# EasyEDA Pro project DualModeKeyboard.eprj

# Schematic Schematic1
Create Date: 2023-08-28; Page Name: P1; Project Name: DualModeKeyboard; Schematic Name: Schematic1; Update Date: 2023-10-23; Company: xChenNing; Drawed: xChenNing; Page Size: A4; Reviewed: xChenNing; Version: V1.0
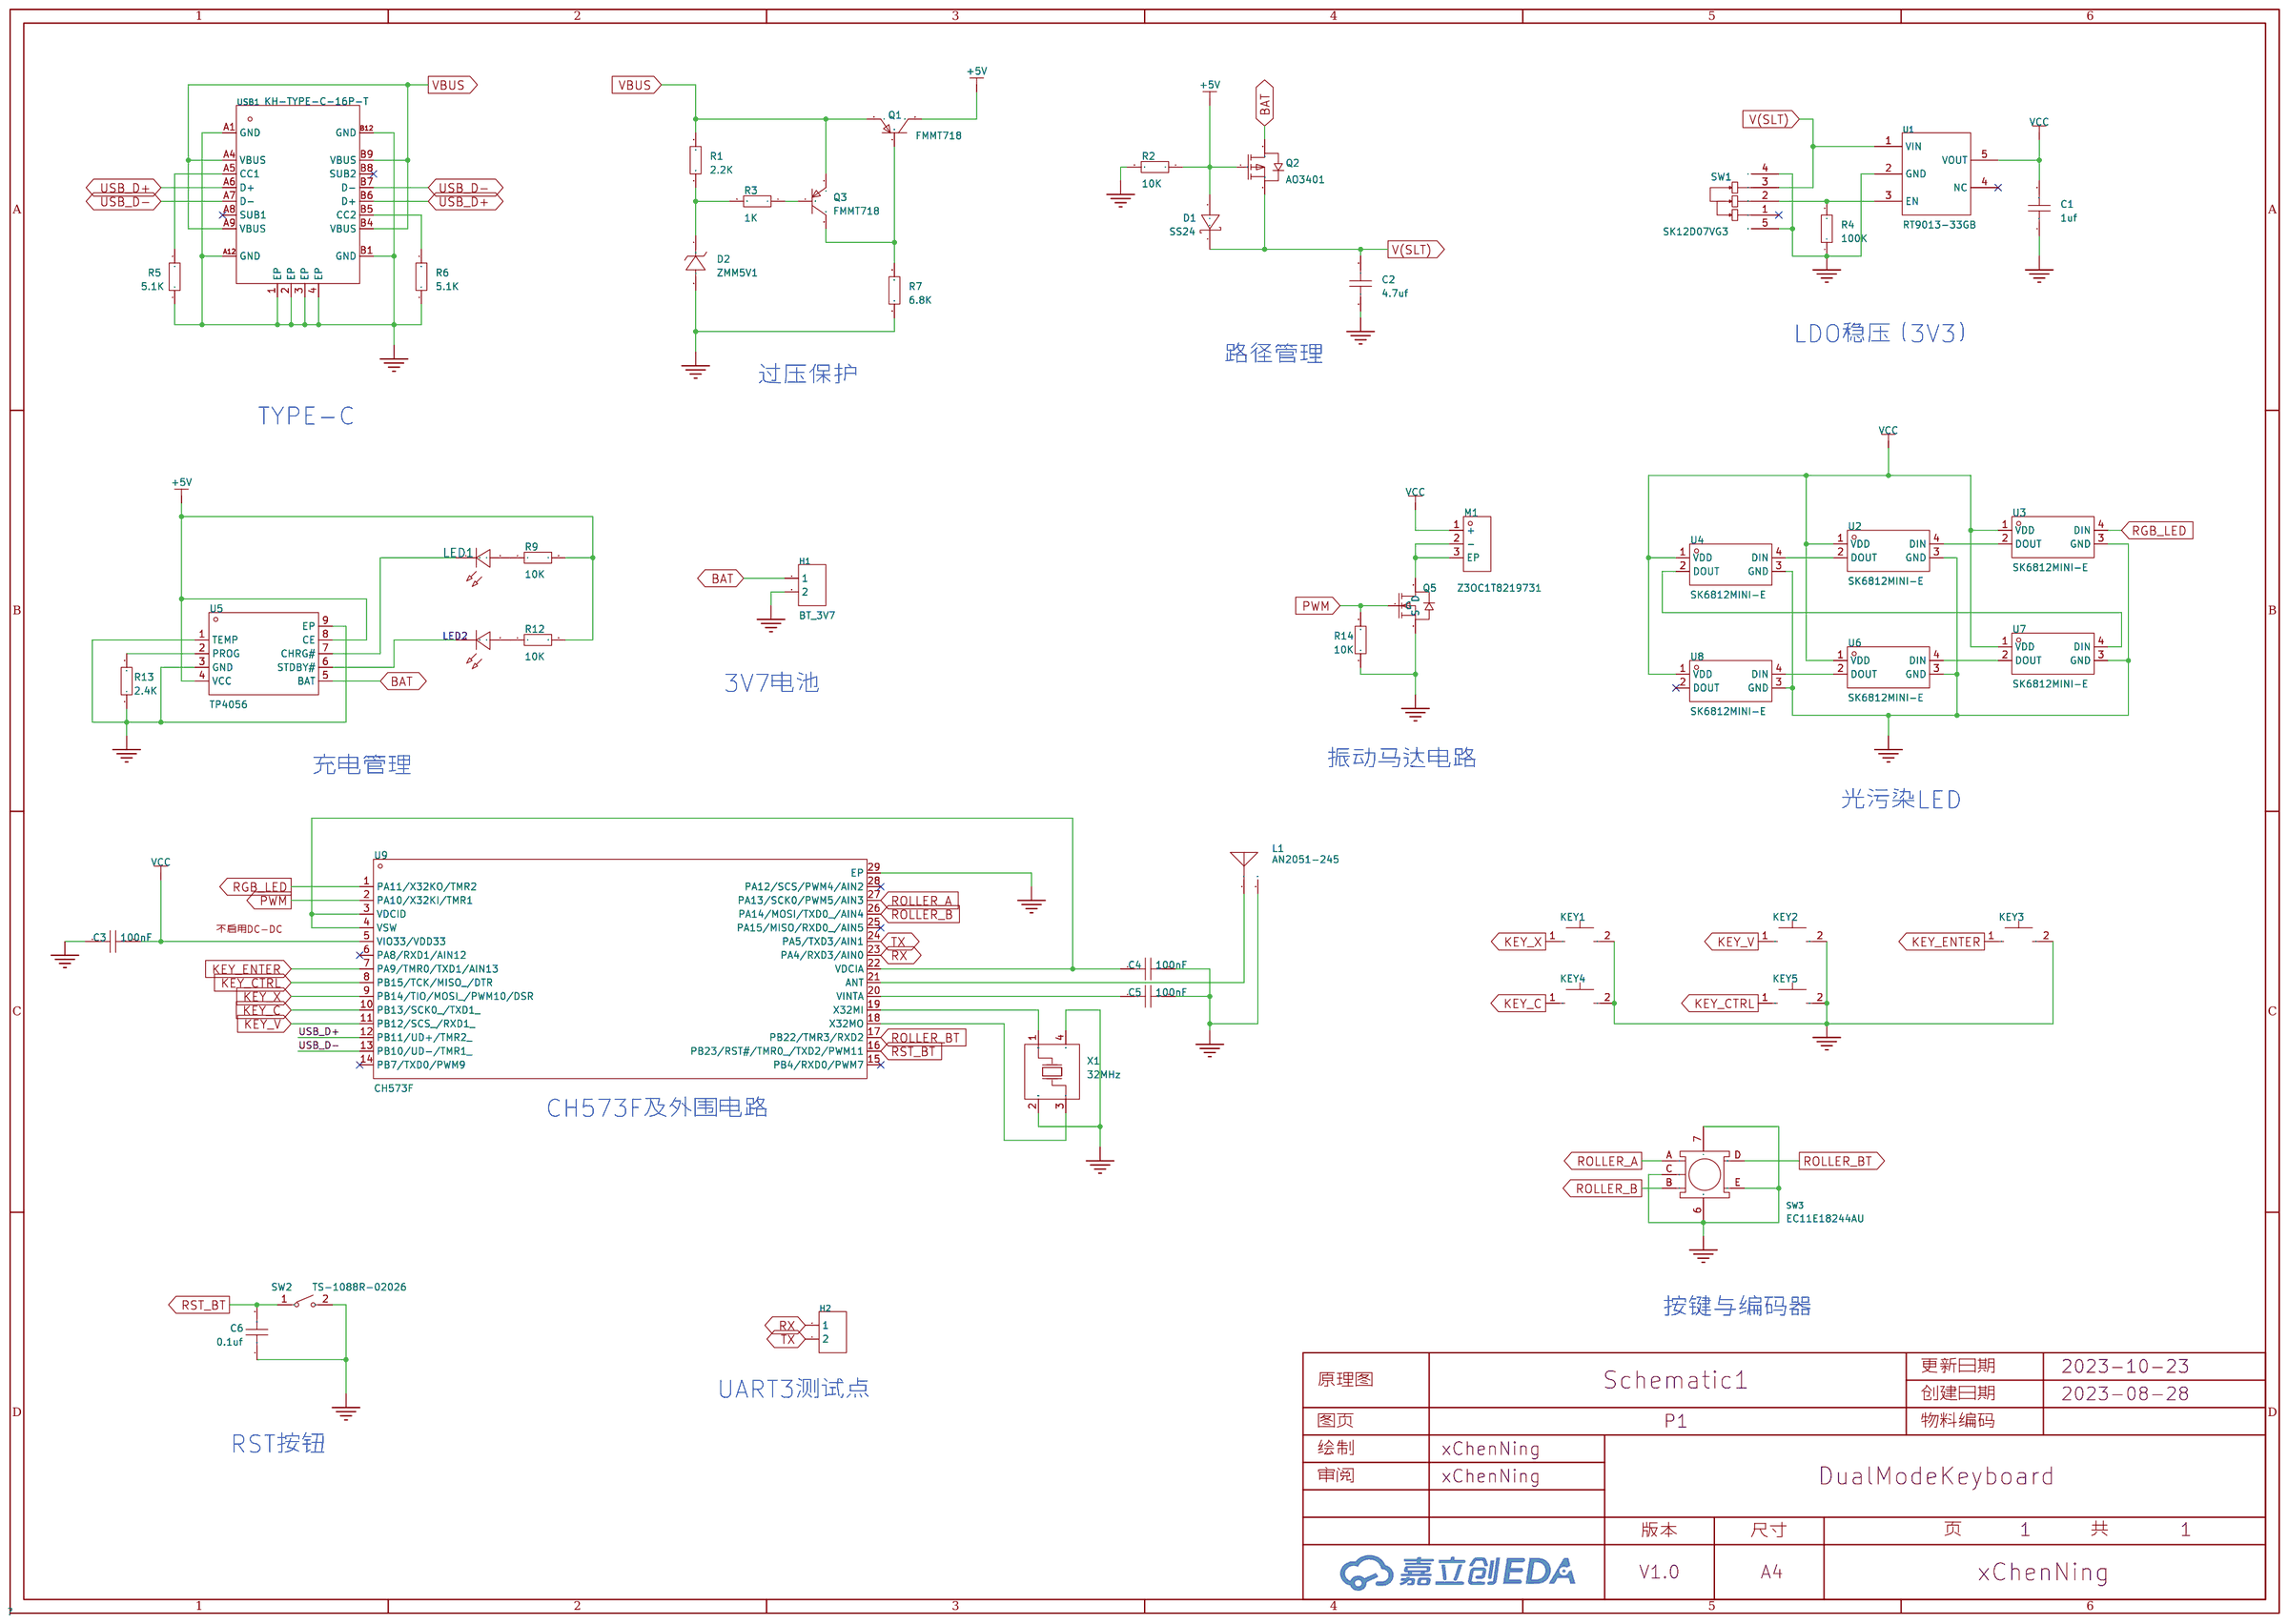
[diagram p0: schematic sheet]

## Parts
C1  1uf  [C0805]
C2  4.7uf  [C0805]
C3  100nF  [C0603]
C4  100nF  [C0603]
C5  100nF  [C0603]
C6  0.1uf  [C0805]
D1  SS24  [SMA_L4.3-W2.6-LS5.2-RD]
D2  ZMM5V1  [LL-34_L3.5-W1.5-RD]
H1  BT_3V7  [HDR-TH_2P-P2.54-V-F]
H2  -  [HDR-TH_2P-P2.54-V-F]
KEY1  CPG151101S11  [AxisSeat_14_18_XCN1]
KEY2  CPG151101S11  [AxisSeat_14_18_XCN1]
KEY3  CPG151101S11  [AxisSeat_14_18_XCN1]
KEY4  CPG151101S11  [AxisSeat_14_18_XCN1]
KEY5  CPG151101S11  [AxisSeat_14_18_XCN1]
L1  AN2051-245  [ANT2051]
LED1  -  [LED_0805]
LED2  -  [LED_0805]
M1  Z3OC1T8219731  [VIBRATING-MOTOR-SMD_3P-C9900001680]
Q1  FMMT718  [SOT-23-3_L2.9-W1.3-P1.90-LS2.4-BR]
Q2  AO3401  [SOT-23-3_L2.9-W1.4-P1.90-LS2.6-BR]
Q3  FMMT718  [SOT-23-3_L2.9-W1.3-P1.90-LS2.4-BR]
Q5  -  [SOT-23-3_L2.9-W1.3-P1.90-LS2.4-BR]
R1  2.2K  [R0805]
R2  10K  [R0805]
R3  1K  [R0805]
R4  100K  [R0805]
R5  5.1K  [R0805]
R6  5.1K  [R0805]
R7  6.8K  [R0805]
R9  10K  [R0805]
R12  10K  [R0805]
R13  2.4K  [R0805]
R14  10K  [R0805]
SW1  SK12D07VG3  [SW-TH_SK12D07VG3]
SW2  TS-1088R-02026  [SW-SMD_L3.9-W3.0-P4.45]
SW3  EC11E18244AU  [SW-TH_EC11XXXXXXXX]
U1  RT9013-33GB  [SOT-23-5_L3.0-W1.7-P0.95-LS2.8-BL]
U2  SK6812MINI-E  [LED-SMD_L3.2-W2.8-TR]
U3  SK6812MINI-E  [LED-SMD_L3.2-W2.8-TR]
U4  SK6812MINI-E  [LED-SMD_L3.2-W2.8-TR]
U5  TP4056  [ESOP-8_L4.9-W3.9-P1.27-LS6.0-BL-EP]
U6  SK6812MINI-E  [LED-SMD_L3.2-W2.8-TR]
U7  SK6812MINI-E  [LED-SMD_L3.2-W2.8-TR]
U8  SK6812MINI-E  [LED-SMD_L3.2-W2.8-TR]
U9  CH573F  [QFN-28_L4.0-W4.0-P0.40-BL-EP]
USB1  KH-TYPE-C-16P-T  [USB-C-SMD_KH-TYPE-C-16P]
X1  32MHz  [OSC-SMD_4P-L2.0-W1.6-BL]

## Library data of the parts
C1 C2 C6 = CAP_0805: Supplier Footprint: 0805
C3-C5 = CAP_0603: Supplier Footprint: 0603
D1 = SS24_C50645: 直流反向耐压(Vr):40V;平均整流电流(Io):2A;正向压降(Vf):550mV@2A;; LCSC Part Name: 40V 2A 550mV@2A SMA （相似料：C364270）; Supplier Part: C50645; Manufacturer: MDD; Supplier Footprint: SMA(DO-214AC); JLCPCB Part Class: 扩展库; Datasheet: https://atta.szlcsc.com/upload/public/pdf/source/20190304/C50645_5B6F2047F1B1EB9F2588B24BC6E81306.pdf; Supplier: LCSC; Reverse Voltage (Vr): 40V; Average Rectified Current (Io): 2A; Forward Voltage (Vf@If): 550mV@2A
D2 = ZMM5V1_C707194: 稳压值(标称值):-;精度:-;功率:500mW;反向电流(Ir):100nA@1V;; LCSC Part Name: 500mW; Supplier Part: C707194; Manufacturer: Slkor(萨科微); Supplier Footprint: LL-34; JLCPCB Part Class: 扩展库; Datasheet: https://atta.szlcsc.com/upload/public/pdf/source/20200721/C707184_776B95022AAA01ECB528B9CFDAFDB27C.pdf; Supplier: LCSC; Power Dissipation: 500mW; Reverse Leakage Current (Ir): 100nA@1V
H1 H2 = HDR-F_2.54_1x2P: Supplier Part: C49661; Supplier Footprint: 插件
KEY1-KEY5 = CPG151101S11: LCSC Part Name: 键盘轴连接器; Supplier Part: C2803348; Manufacturer: Kailh(凯华); Supplier Footprint: SMD; JLCPCB Part Class: 扩展库; Datasheet: https://atta.szlcsc.com/upload/public/pdf/source/20220228/B04A6FE76F6176D3365CC186B3035FED.pdf; Supplier: LCSC
L1 = AN2051-245: 小体积，高增益，WIFI，蓝牙，zigBee 2.4G天线; Supplier Part: C99727; Manufacturer: rainsun(霖昱微); Supplier Footprint: 2x5.1mm; JLCPCB Part Class: 扩展库; Datasheet: https://atta.szlcsc.com/upload/public/pdf/source/20170329/1490752053541.pdf; Supplier: LCSC
LED1 = LED_0805-R: Supplier Footprint: 0805
LED2 = LED_0805-G: Supplier Footprint: 0805
M1 = Z3OC1T8219731: 类型:圆柱直流马达;额定电压:2.7V;额定电流:85mA;额定转速:14000±2500rpm;工作温度:-20℃~+70℃;旋转方向:CW;; Supplier Part: C2894731; Manufacturer: KOTL(金龙机电); JLCPCB Part Class: 扩展库; Datasheet: https://atta.szlcsc.com/upload/public/pdf/source/20210908/21604D4C77F5141C93AFC2CF1DCB74B9.pdf; Supplier: LCSC; Type: 圆柱直流马达; Rated Voltage: 2.7V; Rated Current: 85mA; Rated Speed: 14000±2500rpm; Operating Temperature: -20℃~+70℃; Sense Of Rotation: CW
Q1 Q3 = FMMT718_C5277995: 晶体管类型:PNP;集射极击穿电压(Vceo):20V;集电极电流(Ic):1.5A;; LCSC Part Name: PNP 20V 1.5A; Supplier Part: C5277995; Manufacturer: MSKSEMI(美森科); Supplier Footprint: SOT-23; JLCPCB Part Class: Extended Part; Datasheet: https://atta.szlcsc.com/upload/public/pdf/source/20221121/C72142E7E170B7064C711B5C0E67A49A.pdf; Supplier: LCSC; Transistor Type: PNP; Collector-Emitter Breakdown Voltage (Vceo): 20V; Collector Current (Ic): 1.5A
Q2 = AO3401_C727156: 类型:P沟道;漏源电压(Vdss):30V;连续漏极电流(Id):4.2A;功率(Pd):350mW;导通电阻(RDS(on)@Vgs,Id):65mΩ@10V,4.2A;; LCSC Part Name: P沟道 30V 4.2A; Supplier Part: C727156; Manufacturer: TWGMC(台湾迪嘉); Supplier Footprint: SOT-23; JLCPCB Part Class: 扩展库; Datasheet: https://atta.szlcsc.com/upload/public/pdf/source/20200827/C727156_6E081BBEEFBC6B8FEE164CB196B0AF30.pdf; Supplier: LCSC; Type: P沟道; Drain Source Voltage (Vdss): 30V; Continuous Drain Current (Id): 4.2A; Power Dissipation (Pd): 350mW; Drain Source On Resistance (RDS(on)@Vgs,Id): 65mΩ@10V,4.2A; Gate Threshold Voltage (Vgs(th)@Id): 1.3V@250uA
Q5 = AO3400A_N: 类型:N沟道;漏源电压(Vdss):30V;连续漏极电流(Id):5.2A;功率(Pd):1W;导通电阻(RDS(on)@Vgs,Id):35mΩ@10V,5A;阈值电压(Vgs(th)@Id):1.5V@250μA;; Supplier Footprint: SOT-23; Supplier Part: C700953
R1-R7 R9 R12-R14 = Res_0805: Supplier Footprint: 0805
SW1 = SK12D07VG3: LCSC Part Name: 两档位卧式拨动开关,柄长3MM; Supplier Part: C431547; Manufacturer: SHOU HAN(首韩); Supplier Footprint: 插件; JLCPCB Part Class: 扩展库; Supplier: LCSC
SW2 = TS-1088R-02026: 触点电流:50mA;额定电压(DC):12V;电路结构:单刀单掷;安装方式:立贴;带灯:-;机械寿命:-;; LCSC Part Name: 3.9*2.93*2mm 立贴 轻触开关; Supplier Part: C455280; Manufacturer: XUNPU(讯普); Supplier Footprint: SMD,3x4mm; JLCPCB Part Class: 扩展库; Datasheet: https://atta.szlcsc.com/upload/public/pdf/source/20191118/C455280_718CC4284DAF75EEB0AC8229AE7E40C5.pdf; Supplier: LCSC; Contact Current: 50mA; Voltage Rating (DC): 12V; Circuit: 单刀单掷; Mounting Style: 立贴; Actuator Style: 圆形按钮; Switch Length: 3.9mm; Switch Width: 2.93mm; Switch Height: 2mm
SW3 = EC11E18244AU: Supplier Part: C202365; Manufacturer: ALPSALPINE(阿尔卑斯阿尔派); Supplier Footprint: 插件; JLCPCB Part Class: 扩展库; Datasheet: https://atta.szlcsc.com/upload/public/pdf/source/20180403/C202365_70FA927E879F562641EADC151E1E414A.pdf; Supplier: LCSC
U1 = RT9013-33GB: 输出类型:固定;输出极性:正;最大输入电压:5.5V;输出电压:3.3V;输出电流:500mA;电源纹波抑制比(PSRR):50dB@(10kHz);; LCSC Part Name: 输入5.5V 输出3.3V 500mA; Supplier Part: C47773; Manufacturer: RICHTEK(立锜); Supplier Footprint: SOT-23-5; JLCPCB Part Class: 扩展库; Datasheet: https://atta.szlcsc.com/upload/public/pdf/source/20150504/1457707282459.pdf; Supplier: LCSC; Output Type: 固定; Output Polarity: 正; Number of Outputs: 1; Maximum Input Voltage: 5.5V; Output Voltage: 3.3V; Dropout Voltage: 400mV@(500mA); Quiescent Current (Ground Current): 50uA; Output Current: 500mA; Power Supply Rejection Ratio (PSRR): 50dB@(10kHz); Operating Temperature: -40℃~+85℃
U2-U4 U6-U8 = SK6812MINI-E_C5149201: Supplier Part: C5149201; Manufacturer: 欧思科光电; Supplier Footprint: SMD; JLCPCB Part Class: 扩展库; Supplier: LCSC
U5 = TP4056_C725790: Supplier Part: C725790; Manufacturer: UMW(友台半导体); Supplier Footprint: ESOP-8; JLCPCB Part Class: 扩展库; Datasheet: https://atta.szlcsc.com/upload/public/pdf/source/20211011/37515E71BA298E23D23475482C49633D.pdf; Supplier: LCSC
U9 = CH573F: Supplier Part: C2830434; Supplier Footprint: QFN-28; JLCPCB Part Class: 扩展库; Datasheet: https://atta.szlcsc.com/upload/public/pdf/source/20211009/C2830434_9B1CC9FF0455758F5FF7F545AE5FEE38.pdf; Supplier: LCSC
USB1 = KH-TYPE-C-16P-T: 连接器类型:Type-C;标准:-;公母:母座;触点数量:16P;端口数量:1;安装方式:卧贴;额定电流 - 电源:500mA;工作温度范围:-30℃~+80℃;; LCSC Part Name: Type-C 母座 卧贴; Supplier Part: C709358; Manufacturer: kinghelm(金航标); Supplier Footprint: SMD; JLCPCB Part Class: 扩展库; Datasheet: https://atta.szlcsc.com/upload/public/pdf/source/20200722/C709358_5A99A991362FD50EC94EB58A838F95BB.pdf; Supplier: LCSC; Connector Type: Type-C; Gender: 母座; Number of Contacts: 16P; Number of Ports: 1; Mounting Style: 卧贴; Current Rating - Power (Max): 500mA; Operating Temperature Range: -30℃~+80℃
X1 = X201632MMB4SI: 频率:32MHz;频率公差:±10ppm;负载电容:10pF;; LCSC Part Name: 32MHz ±10ppm 10pF YSX211SL; Supplier Part: C383840; Manufacturer: YXC(扬兴晶振); Supplier Footprint: SMD2016-4P; JLCPCB Part Class: 扩展库; Datasheet: https://atta.szlcsc.com/upload/public/pdf/source/20210329/C108154_97241DDF47B5B71D7D93F8906D63DA2F.pdf; Supplier: LCSC; Crystal Type: 贴片无源晶振; Frequency Tolerance: ±10ppm; Frequency Stability: ±20ppm; Load Capacitance: 10pF; Operating Temperature: -40℃~+85℃

## Nets
+5V: D1.2(A) Q1.3(C) Q2.1(G) R2.1 R9.2 R12.2 U5.4(VCC) U5.8(CE)
GND: C1.1 C2.1 C3.1 C4.2 C5.2 C6.1 D2.2(A) H1.2 KEY1.2 KEY2.2 KEY3.2 KEY4.2 KEY5.2 L1.2 Q5.2(S) R2.2 R4.1 R5.1 R6.1 R7.1 R13.1 R14.1 SW1.4 SW1.5 SW2.2 SW3.6 SW3.7 SW3.C SW3.E U1.2(GND) U2.3(GND) U3.3(GND) U4.3(GND) U5.1(TEMP) U5.3(GND) U5.9(EP) U6.3(GND) U7.3(GND) U8.3(GND) U9.29(EP) USB1.1(EP) USB1.2(EP) USB1.3(EP) USB1.4(EP) USB1.A1(GND) USB1.A12(GND) USB1.B1(GND) USB1.B12(GND) X1.2(GND) X1.4(GND)
VBUS: Q1.2(E) Q3.2(E) R1.2 USB1.A4(VBUS) USB1.A9(VBUS) USB1.B4(VBUS) USB1.B9(VBUS)
VCC: C1.2 C3.2 M1.1(+) U1.5(VOUT) U2.1(VDD) U3.1(VDD) U4.1(VDD) U6.1(VDD) U7.1(VDD) U8.1(VDD) U9.5(VIO33/VDD33)
BAT: H1.1 Q2.3(D) U5.5(BAT)
KEY_C: KEY4.1 U9.10(PB13/SCK0_/TXD1_)
KEY_CTRL: KEY5.1 U9.8(PB15/TCK/MISO_/DTR)
KEY_ENTER: KEY3.1 U9.7(PA9/TMR0/TXD1/AIN13)
KEY_V: KEY2.1 U9.11(PB12/SCS_/RXD1_)
KEY_X: KEY1.1 U9.9(PB14/TIO/MOSI_/PWM10/DSR)
PWM: Q5.1(G) R14.2 U9.2(PA10/X32KI/TMR1)
RGB_LED: U3.4(DIN) U9.1(PA11/X32KO/TMR2)
ROLLER_A: SW3.A U9.27(PA13/SCK0/PWM5/AIN3)
ROLLER_B: SW3.B U9.26(PA14/MOSI/TXD0_/AIN4)
ROLLER_BT: SW3.D U9.17(PB22/TMR3/RXD2)
RST_BT: C6.2 SW2.1 U9.16(PB23/RST#/TMR0_/TXD2/PWM11)
RX: H2.1 U9.23(PA4/RXD3/AIN0)
TX: H2.2 U9.24(PA5/TXD3/AIN1)
USB_D+: U9.12(PB11/UD+/TMR2_) USB1.A6(D+) USB1.B6(D+)
USB_D-: U9.13(PB10/UD-/TMR1_) USB1.A7(D-) USB1.B7(D-)
V(SLT): C2.2 D1.1(K) Q2.2(S) SW1.3 U1.1(VIN)
$1N588: C5.1 U9.20(VINTA)
$1N5446: R5.2 USB1.A5(CC1)
$1N5462: R6.2 USB1.B5(CC2)
$1N6903: R4.2 SW1.2 U1.3(EN)
$1N8513: LED1.1(C) U5.7(CHRG#)
$1N8523: LED2.1(C) U5.6(STDBY#)
$1N8602: LED1.2(A) R9.1
$1N8604: LED2.2(A) R12.1
$1N8691: R13.2 U5.2(PROG)
$1N9465: C4.1 U9.3(VDCID) U9.4(VSW) U9.22(VDCIA)
$1N9696: U9.18(X32MO) X1.3(OSC2)
$1N9702: U9.19(X32MI) X1.1(OSC1)
$1N12595: D2.1(C) R1.1 R3.2
$1N12597: Q3.1(B) R3.1
$1N12605: Q1.1(B) Q3.3(C) R7.2
$1N13146: L1.1(ANT) U9.21(ANT)
$1N19892: U2.4(DIN) U3.2(DOUT)
$1N19911: U6.4(DIN) U7.2(DOUT)
$1N19914: U6.2(DOUT) U8.4(DIN)
$1N19980: U2.2(DOUT) U4.4(DIN)
$1N19985: U4.2(DOUT) U7.4(DIN)
$1N28669: M1.2(-) M1.3(EP) Q5.3(D)

Not connected (* = marked no-connect by the designer): SW1 1*; U1 4(NC)*; U8 2(DOUT)*; U9 6(PA8/RXD1/AIN12)* 14(PB7/TXD0/PWM9)* 15(PB4/RXD0/PWM7)* 25(PA15/MISO/RXD0_/AIN5)* 28(PA12/SCS/PWM4/AIN2)*; USB1 A8(SUB1)* B8(SUB2)*

## Notes on the sheet
- LDO稳压（3V3）
- 路径管理
- 过压保护
- TYPE-C
- 3V7电池
- 充电管理
- 振动马达电路
- 光污染LED
- 不启用DC-DC
- CH573F及外围电路
- 按键与编码器
- UART3测试点
- RST按钮

# Board PCB1
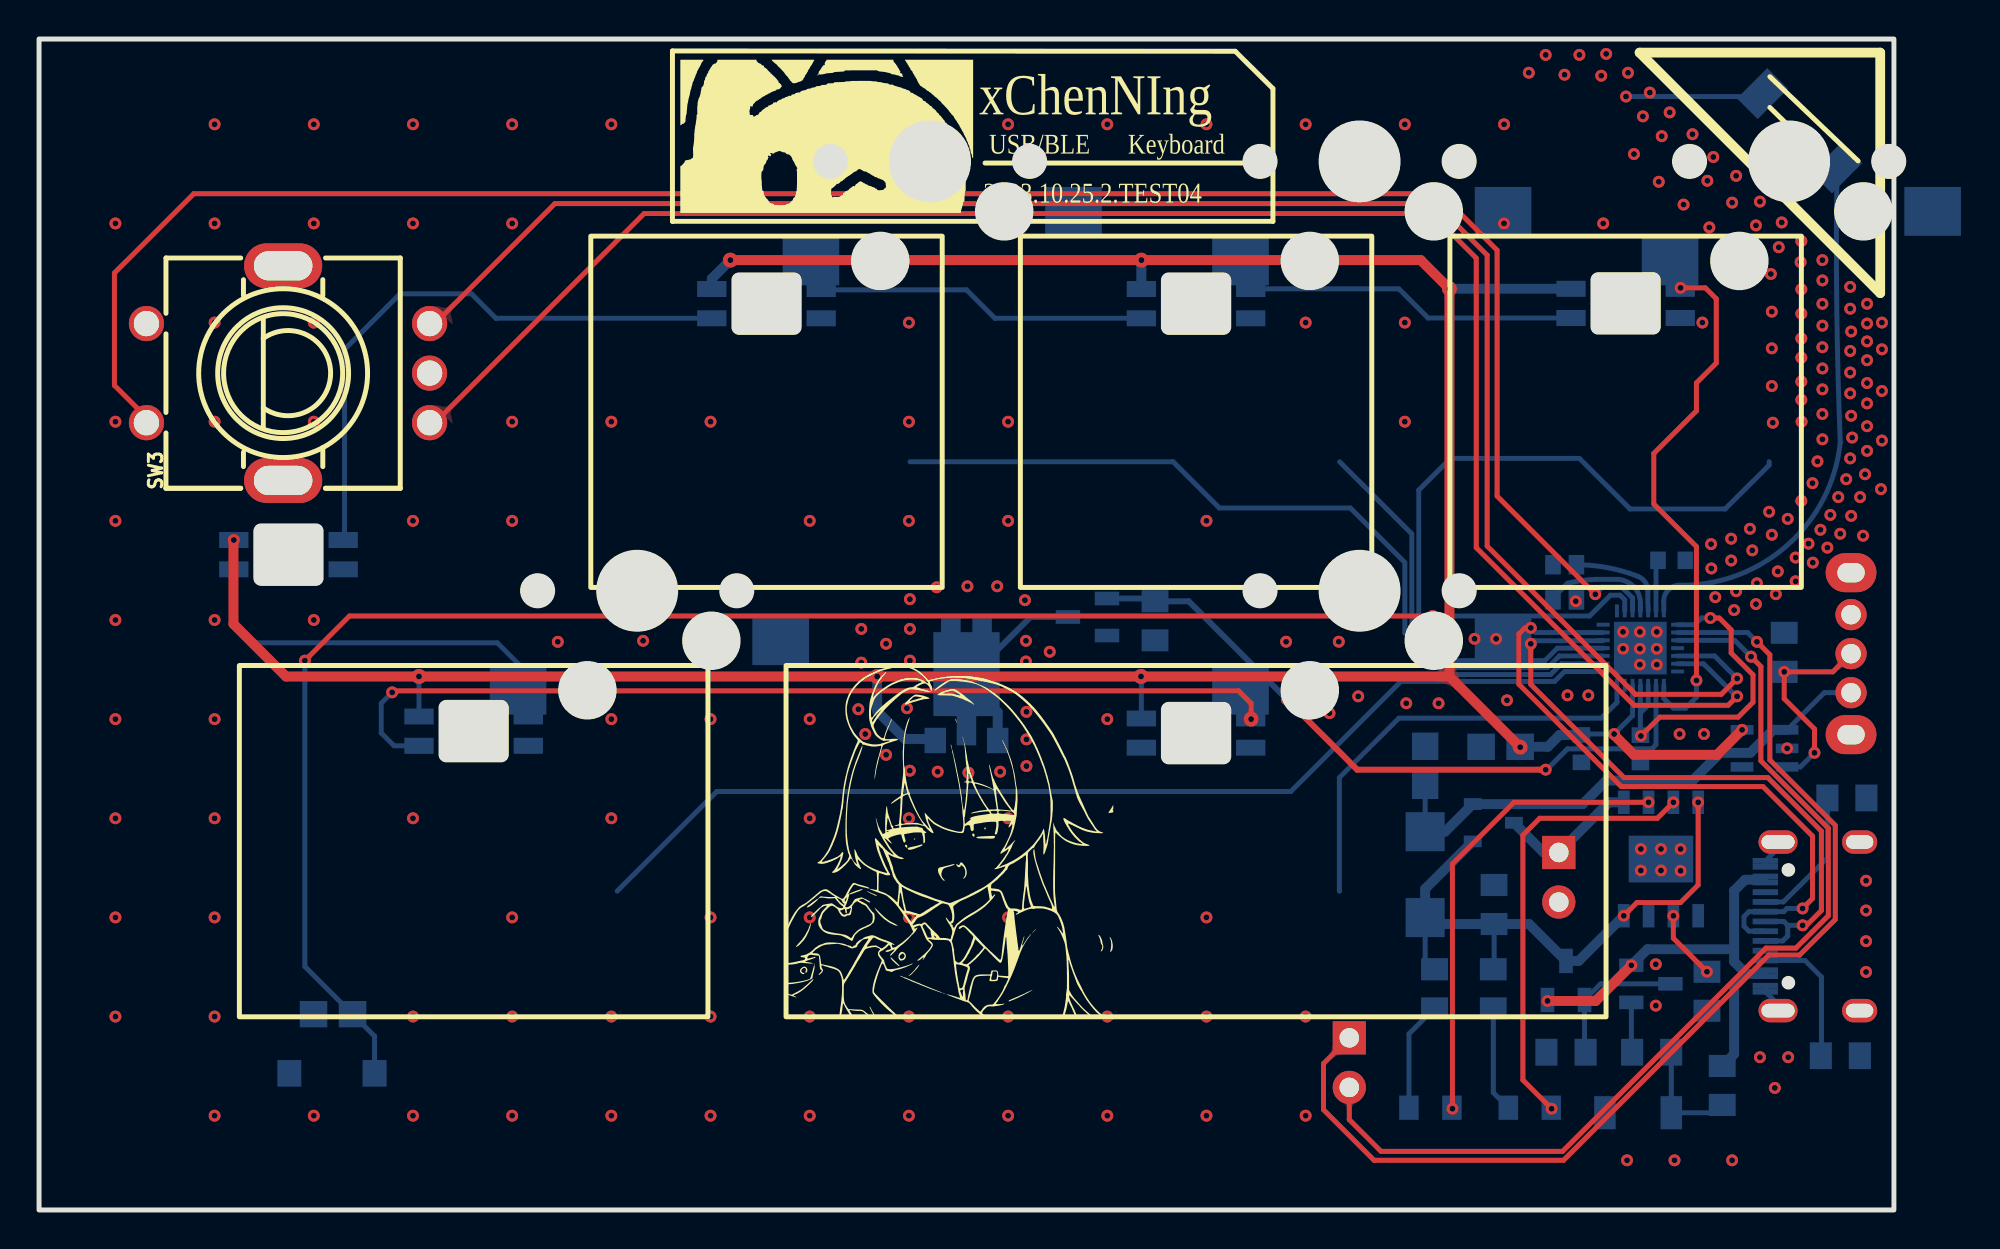
[diagram p1: board, top side]